# Altium schematic sheet LDD.SchDoc: Evaluation Board 3.2
size A3; Organization: Toradex AG; Address1: Altsagenstrasse 5; Address2: Horw; Address3: 6048; Address4: Switzerland; DocumentNumber: 12; Revision: V3.2; SheetNumber: 12; SheetTotal: 23; PageSetup: Record=PageOptions|CenterHorizontal=True|CenterVertical=True|PrintScale=0.73|XCorrection=1.00|YCorrection=1.00|PrintKind=0|BorderSize=5000000|LeftOffset=0|BottomOffset=0|Orientation=2|PaperLength=1000|PaperWidth=1000|Scale=100|PaperSource=7|PrintQuality=-4|MediaType=1|DitherType=10|PaperKind=A4|PrintScaleMode=1
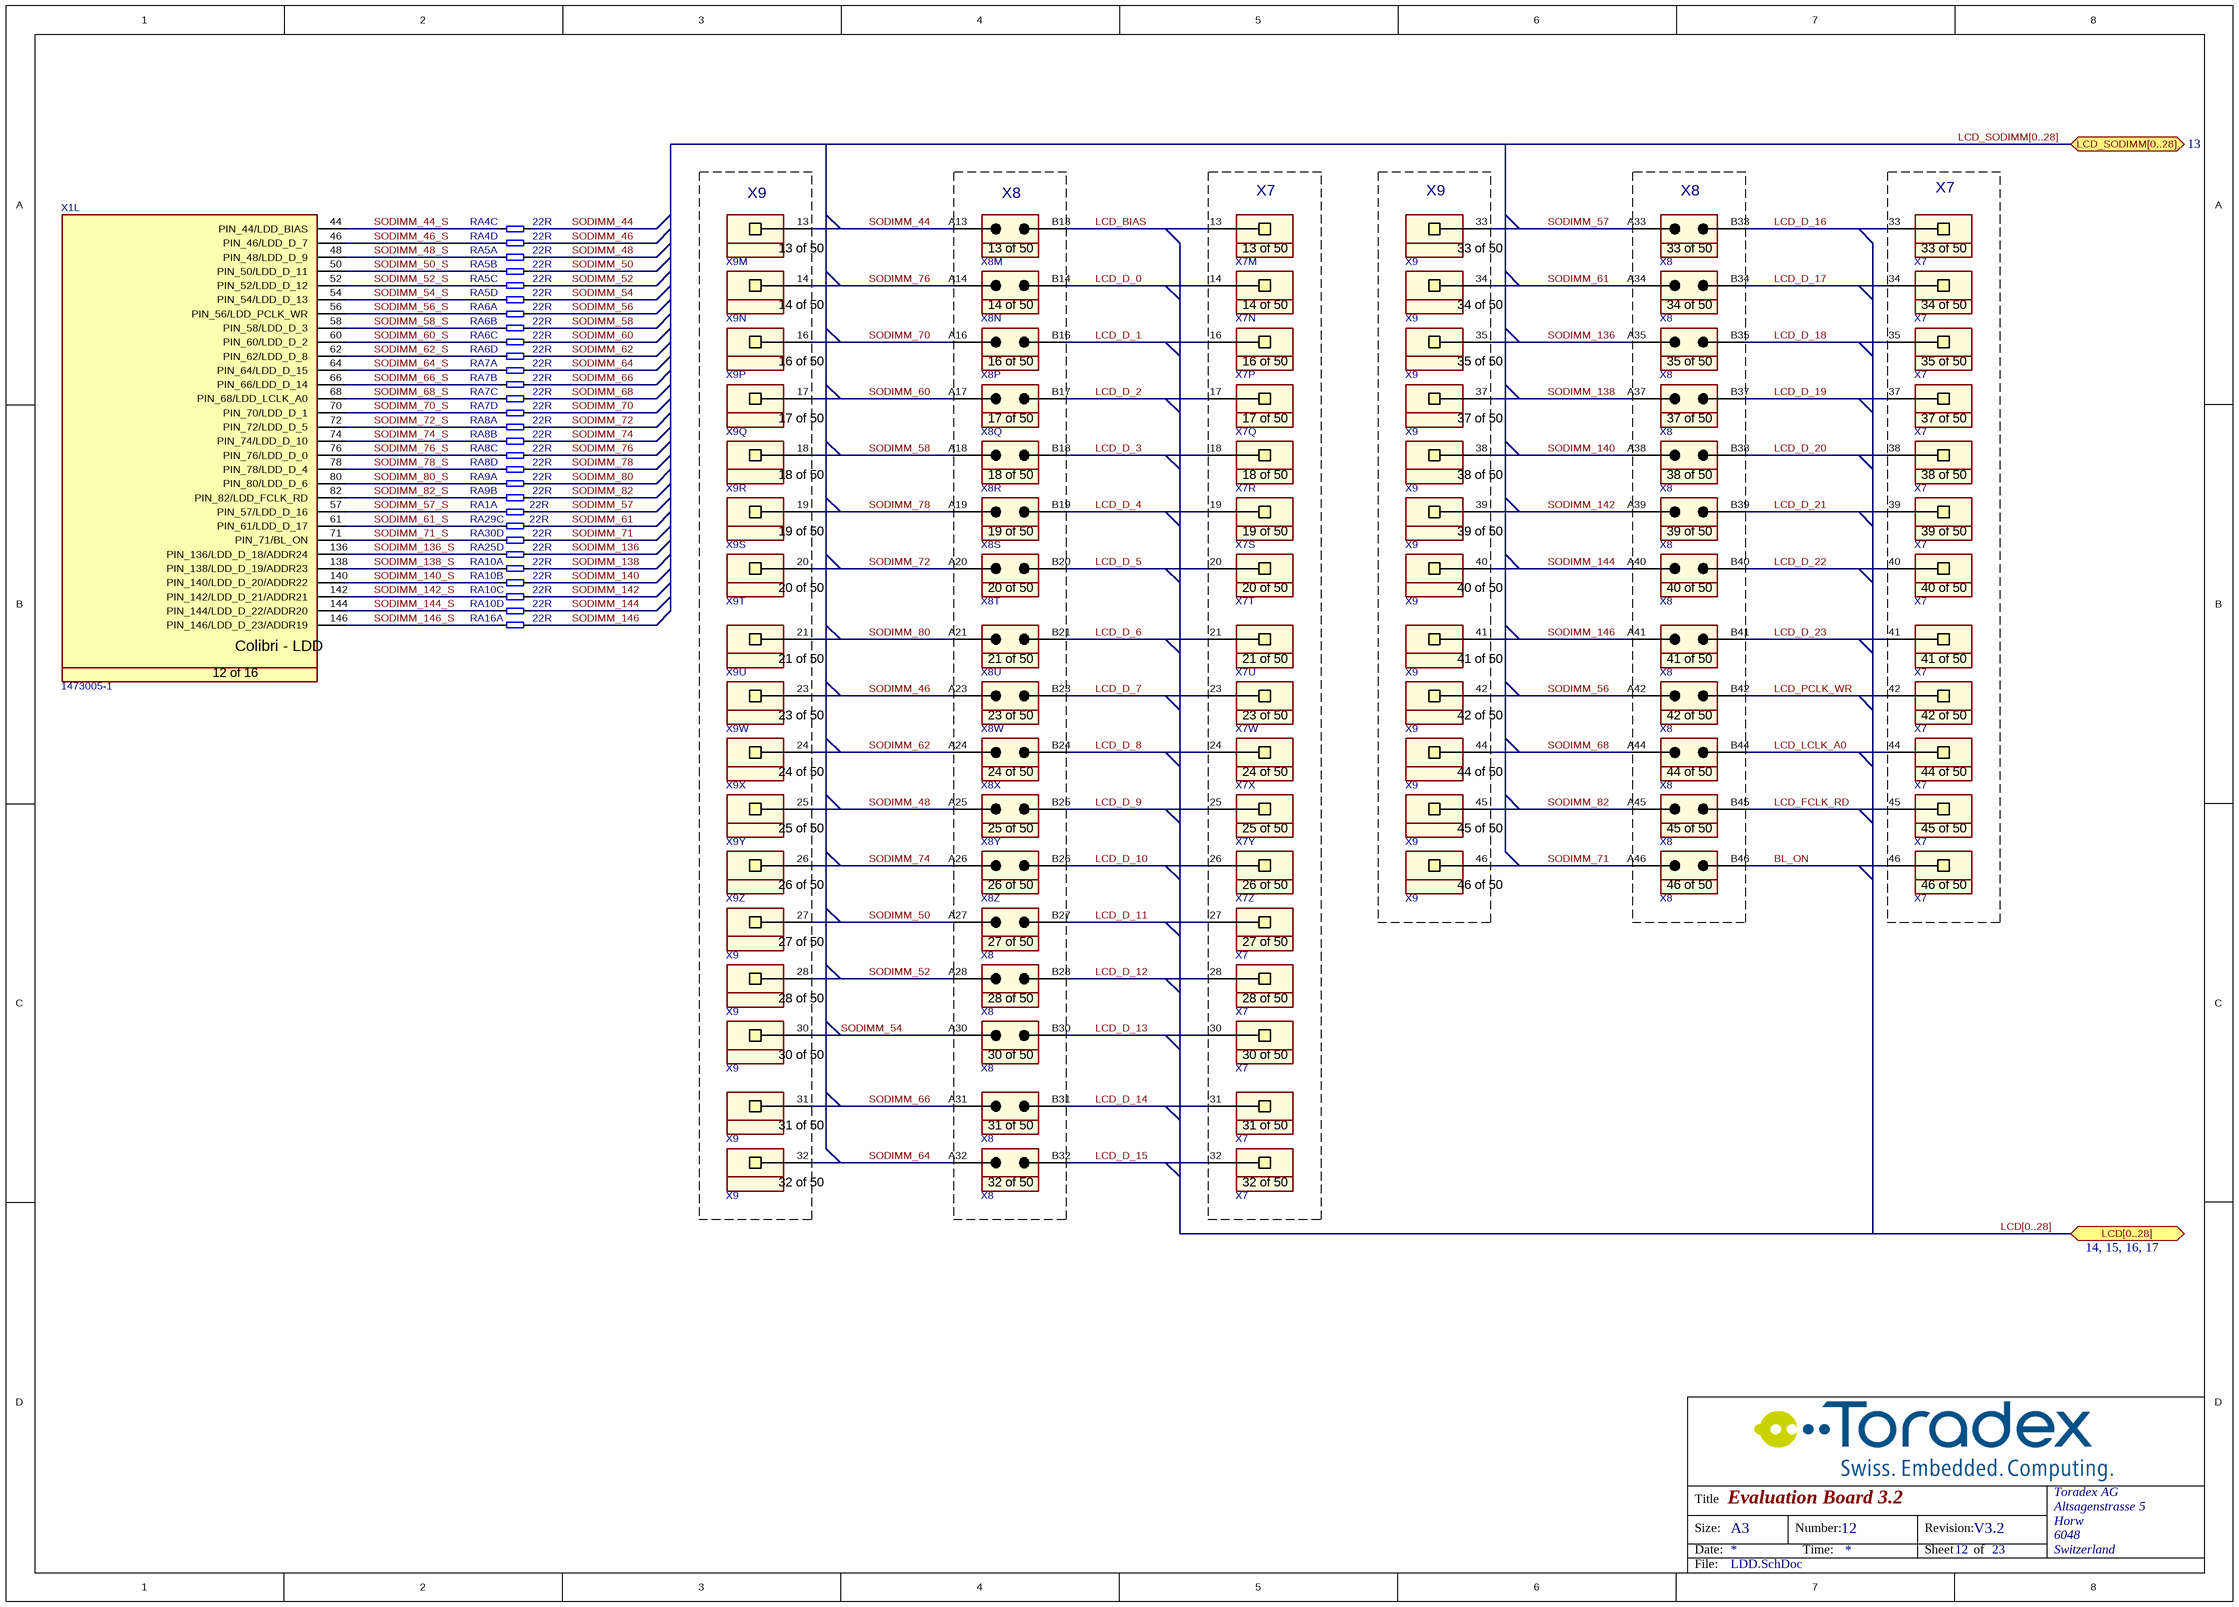
[diagram p0: LDD.SchDoc]

## Parts
RA1  22R  [T_Resistor_Array_X4]  (part A of 4)
RA4  22R  [T_Resistor_Array_X4]  (parts C,D of 4)
RA5  22R  [T_Resistor_Array_X4]  (parts A,B,C,D of 4)
RA6  22R  [T_Resistor_Array_X4]  (parts A,B,C,D of 4)
RA7  22R  [T_Resistor_Array_X4]  (parts A,B,C,D of 4)
RA8  22R  [T_Resistor_Array_X4]  (parts A,B,C,D of 4)
RA9  22R  [T_Resistor_Array_X4]  (parts A,B of 4)
RA10  22R  [T_Resistor_Array_X4]  (parts A,B,C,D of 4)
RA16  22R  [T_Resistor_Array_X4]  (part A of 4)
RA25  22R  [T_Resistor_Array_X4]  (part D of 4)
RA29  22R  [T_Resistor_Array_X4]  (part C of 4)
RA30  22R  [T_Resistor_Array_X4]  (part D of 4)
X1  Manufacturer Part No.: 1473005-1  [T_Tyco_1473005-1]  (hidden comment: CON-Tyco-1473005-1-200-0.6mm)  (part L of 16)
X7  SSW-110-01-G-S  [T_Samtec_SSW-110-01-G-S]  (value not drawn)  (parts M,N,P,Q,R,S,T,U,W,X,Y,Z,27,28,30,31,32,33,34,35,37,38,39,40,41,42,44,45,46 of 50)
X8  TSW-110-07-G-D  [T_Samtec_TSW-110-07-G-D]  (value not drawn)  (parts M,N,P,Q,R,S,T,U,W,X,Y,Z,27,28,30,31,32,33,34,35,37,38,39,40,41,42,44,45,46 of 50)
X9  SSW-110-01-G-S  [T_Samtec_SSW-110-01-G-S]  (value not drawn)  (parts M,N,P,Q,R,S,T,U,W,X,Y,Z,27,28,30,31,32,33,34,35,37,38,39,40,41,42,44,45,46 of 50)

## Blocks framed on the sheet
X9: X9
X8: X8
X7: X7
X9: X9
X8: X8
X7: X7

## Ports
LCD[0..28] (bidir, see 14, 15, 16, 17), LCD_SODIMM[0..28] (bidir, see 13)

## Nets
BL_ON: X7.46 X8.B46
LCD_BIAS: X7.13 X8.B13
LCD_D_0: X7.14 X8.B14
LCD_D_1: X7.16 X8.B16
LCD_D_2: X7.17 X8.B17
LCD_D_3: X7.18 X8.B18
LCD_D_4: X7.19 X8.B19
LCD_D_5: X7.20 X8.B20
LCD_D_6: X7.21 X8.B21
LCD_D_7: X7.23 X8.B23
LCD_D_8: X7.24 X8.B24
LCD_D_9: X7.25 X8.B25
LCD_D_10: X7.26 X8.B26
LCD_D_11: X7.27 X8.B27
LCD_D_12: X7.28 X8.B28
LCD_D_13: X7.30 X8.B30
LCD_D_14: X7.31 X8.B31
LCD_D_15: X7.32 X8.B32
LCD_D_16: X7.33 X8.B33
LCD_D_17: X7.34 X8.B34
LCD_D_18: X7.35 X8.B35
LCD_D_19: X7.37 X8.B37
LCD_D_20: X7.38 X8.B38
LCD_D_21: X7.39 X8.B39
LCD_D_22: X7.40 X8.B40
LCD_D_23: X7.41 X8.B41
LCD_FCLK_RD: X7.45 X8.B45
LCD_LCLK_A0: X7.44 X8.B44
LCD_PCLK_WR: X7.42 X8.B42
SODIMM_44: RA4.7 X8.A13 X9.13
SODIMM_44_S: RA4.3 X1.44(PIN_44/LDD_BIAS)
SODIMM_46: RA4.8 X8.A23 X9.23
SODIMM_46_S: RA4.4 X1.46(PIN_46/LDD_D_7)
SODIMM_48: RA5.5 X8.A25 X9.25
SODIMM_48_S: RA5.1 X1.48(PIN_48/LDD_D_9)
SODIMM_50: RA5.6 X8.A27 X9.27
SODIMM_50_S: RA5.2 X1.50(PIN_50/LDD_D_11)
SODIMM_52: RA5.7 X8.A28 X9.28
SODIMM_52_S: RA5.3 X1.52(PIN_52/LDD_D_12)
SODIMM_54: RA5.8 X8.A30 X9.30
SODIMM_54_S: RA5.4 X1.54(PIN_54/LDD_D_13)
SODIMM_56: RA6.5 X8.A42 X9.42
SODIMM_56_S: RA6.1 X1.56(PIN_56/LDD_PCLK_WR)
SODIMM_57: RA1.5 X8.A33 X9.33
SODIMM_57_S: RA1.1 X1.57(PIN_57/LDD_D_16)
SODIMM_58: RA6.6 X8.A18 X9.18
SODIMM_58_S: RA6.2 X1.58(PIN_58/LDD_D_3)
SODIMM_60: RA6.7 X8.A17 X9.17
SODIMM_60_S: RA6.3 X1.60(PIN_60/LDD_D_2)
SODIMM_61: RA29.7 X8.A34 X9.34
SODIMM_61_S: RA29.3 X1.61(PIN_61/LDD_D_17)
SODIMM_62: RA6.8 X8.A24 X9.24
SODIMM_62_S: RA6.4 X1.62(PIN_62/LDD_D_8)
SODIMM_64: RA7.5 X8.A32 X9.32
SODIMM_64_S: RA7.1 X1.64(PIN_64/LDD_D_15)
SODIMM_66: RA7.6 X8.A31 X9.31
SODIMM_66_S: RA7.2 X1.66(PIN_66/LDD_D_14)
SODIMM_68: RA7.7 X8.A44 X9.44
SODIMM_68_S: RA7.3 X1.68(PIN_68/LDD_LCLK_A0)
SODIMM_70: RA7.8 X8.A16 X9.16
SODIMM_70_S: RA7.4 X1.70(PIN_70/LDD_D_1)
SODIMM_71: RA30.8 X8.A46 X9.46
SODIMM_71_S: RA30.4 X1.71(PIN_71/BL_ON)
SODIMM_72: RA8.5 X8.A20 X9.20
SODIMM_72_S: RA8.1 X1.72(PIN_72/LDD_D_5)
SODIMM_74: RA8.6 X8.A26 X9.26
SODIMM_74_S: RA8.2 X1.74(PIN_74/LDD_D_10)
SODIMM_76: RA8.7 X8.A14 X9.14
SODIMM_76_S: RA8.3 X1.76(PIN_76/LDD_D_0)
SODIMM_78: RA8.8 X8.A19 X9.19
SODIMM_78_S: RA8.4 X1.78(PIN_78/LDD_D_4)
SODIMM_80: RA9.5 X8.A21 X9.21
SODIMM_80_S: RA9.1 X1.80(PIN_80/LDD_D_6)
SODIMM_82: RA9.6 X8.A45 X9.45
SODIMM_82_S: RA9.2 X1.82(PIN_82/LDD_FCLK_RD)
SODIMM_136: RA25.8 X8.A35 X9.35
SODIMM_136_S: RA25.4 X1.136(PIN_136/LDD_D_18/ADDR24)
SODIMM_138: RA10.5 X8.A37 X9.37
SODIMM_138_S: RA10.1 X1.138(PIN_138/LDD_D_19/ADDR23)
SODIMM_140: RA10.6 X8.A38 X9.38
SODIMM_140_S: RA10.2 X1.140(PIN_140/LDD_D_20/ADDR22)
SODIMM_142: RA10.7 X8.A39 X9.39
SODIMM_142_S: RA10.3 X1.142(PIN_142/LDD_D_21/ADDR21)
SODIMM_144: RA10.8 X8.A40 X9.40
SODIMM_144_S: RA10.4 X1.144(PIN_144/LDD_D_22/ADDR20)
SODIMM_146: RA16.5 X8.A41 X9.41
SODIMM_146_S: RA16.1 X1.146(PIN_146/LDD_D_23/ADDR19)

## Buses and harness runs
bus LCD[0..28] = port LCD[0..28]
bus LCD_SODIMM[0..28] = port LCD_SODIMM[0..28]

## Notes on the sheet
- Title
- Size:
- Date:
- A3
- Number:
- Time:
- Revision:
- Sheet
- of
- File:
- (in symbol CON-Samtec-SSW-110-01-G-S, part M) 13 of 50
- (in symbol CON-Samtec-SSW-110-01-G-S, part N) 14 of 50
- (in symbol CON-Samtec-SSW-110-01-G-S, part P) 16 of 50
- (in symbol CON-Samtec-SSW-110-01-G-S, part Q) 17 of 50
- (in symbol CON-Samtec-SSW-110-01-G-S, part R) 18 of 50
- (in symbol CON-Samtec-SSW-110-01-G-S, part S) 19 of 50
- (in symbol CON-Samtec-SSW-110-01-G-S, part T) 20 of 50
- (in symbol CON-Samtec-SSW-110-01-G-S, part U) 21 of 50
- (in symbol CON-Samtec-SSW-110-01-G-S, part W) 23 of 50
- (in symbol CON-Samtec-SSW-110-01-G-S, part X) 24 of 50
- (in symbol CON-Samtec-SSW-110-01-G-S, part Y) 25 of 50
- (in symbol CON-Samtec-SSW-110-01-G-S, part Z) 26 of 50
- (in symbol CON-Samtec-SSW-110-01-G-S, part 27) 27 of 50
- (in symbol CON-Samtec-SSW-110-01-G-S, part 28) 28 of 50
- (in symbol CON-Samtec-SSW-110-01-G-S, part 30) 30 of 50
- (in symbol CON-Samtec-SSW-110-01-G-S, part 31) 31 of 50
- (in symbol CON-Samtec-SSW-110-01-G-S, part 32) 32 of 50
- (in symbol CON-Samtec-SSW-110-01-G-S, part 33) 33 of 50
- (in symbol CON-Samtec-SSW-110-01-G-S, part 34) 34 of 50
- (in symbol CON-Samtec-SSW-110-01-G-S, part 35) 35 of 50
- (in symbol CON-Samtec-SSW-110-01-G-S, part 37) 37 of 50
- (in symbol CON-Samtec-SSW-110-01-G-S, part 38) 38 of 50
- (in symbol CON-Samtec-SSW-110-01-G-S, part 39) 39 of 50
- (in symbol CON-Samtec-SSW-110-01-G-S, part 40) 40 of 50
- (in symbol CON-Samtec-SSW-110-01-G-S, part 41) 41 of 50
- (in symbol CON-Samtec-SSW-110-01-G-S, part 42) 42 of 50
- (in symbol CON-Samtec-SSW-110-01-G-S, part 44) 44 of 50
- (in symbol CON-Samtec-SSW-110-01-G-S, part 45) 45 of 50
- (in symbol CON-Samtec-SSW-110-01-G-S, part 46) 46 of 50
- (in symbol CON-Samtec-TSW-110-07-G-D, part M) 13 of 50
- (in symbol CON-Samtec-TSW-110-07-G-D, part N) 14 of 50
- (in symbol CON-Samtec-TSW-110-07-G-D, part P) 16 of 50
- (in symbol CON-Samtec-TSW-110-07-G-D, part Q) 17 of 50
- (in symbol CON-Samtec-TSW-110-07-G-D, part R) 18 of 50
- (in symbol CON-Samtec-TSW-110-07-G-D, part S) 19 of 50
- (in symbol CON-Samtec-TSW-110-07-G-D, part T) 20 of 50
- (in symbol CON-Samtec-TSW-110-07-G-D, part U) 21 of 50
- (in symbol CON-Samtec-TSW-110-07-G-D, part W) 23 of 50
- (in symbol CON-Samtec-TSW-110-07-G-D, part X) 24 of 50
- (in symbol CON-Samtec-TSW-110-07-G-D, part Y) 25 of 50
- (in symbol CON-Samtec-TSW-110-07-G-D, part Z) 26 of 50
- (in symbol CON-Samtec-TSW-110-07-G-D, part 27) 27 of 50
- (in symbol CON-Samtec-TSW-110-07-G-D, part 28) 28 of 50
- (in symbol CON-Samtec-TSW-110-07-G-D, part 30) 30 of 50
- (in symbol CON-Samtec-TSW-110-07-G-D, part 31) 31 of 50
- (in symbol CON-Samtec-TSW-110-07-G-D, part 32) 32 of 50
- (in symbol CON-Samtec-TSW-110-07-G-D, part 33) 33 of 50
- (in symbol CON-Samtec-TSW-110-07-G-D, part 34) 34 of 50
- (in symbol CON-Samtec-TSW-110-07-G-D, part 35) 35 of 50
- (in symbol CON-Samtec-TSW-110-07-G-D, part 37) 37 of 50
- (in symbol CON-Samtec-TSW-110-07-G-D, part 38) 38 of 50
- (in symbol CON-Samtec-TSW-110-07-G-D, part 39) 39 of 50
- (in symbol CON-Samtec-TSW-110-07-G-D, part 40) 40 of 50
- (in symbol CON-Samtec-TSW-110-07-G-D, part 41) 41 of 50
- (in symbol CON-Samtec-TSW-110-07-G-D, part 42) 42 of 50
- (in symbol CON-Samtec-TSW-110-07-G-D, part 44) 44 of 50
- (in symbol CON-Samtec-TSW-110-07-G-D, part 45) 45 of 50
- (in symbol CON-Samtec-TSW-110-07-G-D, part 46) 46 of 50
- (in symbol CON-Tyco-1473005-1-200-0.6mm, part L) Colibri - LDD; 12 of 16

## Library data of the parts
RA1 RA4-RA10 RA16 RA25 RA29 RA30 = RA-22R-63mW-5%-1206-div: Resistor Array 22 R 63mW 5% 1206; Tolerance: 5%; Power Dissipation: 63mW; Value: 22R
X1 = CON-Tyco-1473005-1-200-0.6mm: SODIMM Connector; Manufacturer Name: Tyco; No. of ways: 200
X7 X9 = CON-Samtec-SSW-110-01-G-S: Header 1x50 pin 2.54mm pitch; Manufacturer Name: Samtec; Pitch: 2.54mm; No. of ways: 1x50; Manufacturer Part No.: SSW-110-01-G-S
X8 = CON-Samtec-TSW-110-07-G-D: Header 2x50 pin 2.54mm pitch; Manufacturer Name: Samtec; Pitch: 2.54mm; No. of ways: 2x50; Manufacturer Part No.: TSW-110-07-G-D